# Altium schematic sheet MAZ000170 - Diagrama eléctrico.SchDoc: MAZ000170 - Diagrama eléctrico
size A; ApprovedBy: Christian Ledwidth; CheckedBy: Nahuel Martinez; Author: Santiago Marti; CompanyName: Body Health; DrawnBy: Santiago Marti; Revision: A; SheetNumber: 1; SheetTotal: 2
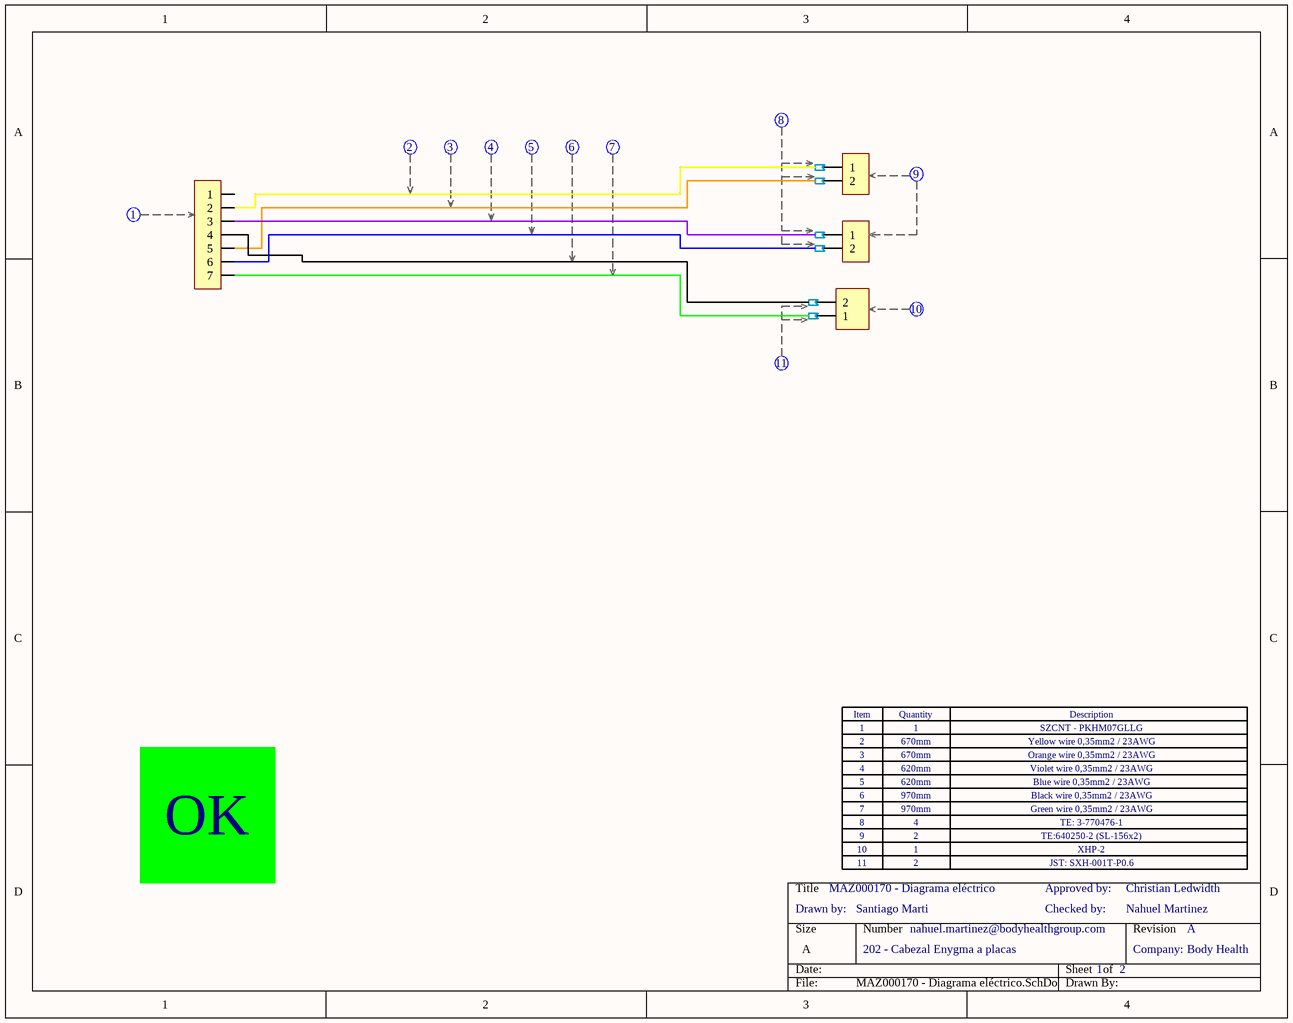
[diagram p0: MAZ000170 - Diagrama eléctrico.SchDoc]

## Parts
Con1  SL156-2  (value not drawn)  (part D of 4)
Con2  SL156-2  (value not drawn)  (part D of 4)
Con3  XHP-2  (value not drawn)  (part D of 4)
Conn1  SZCNT_07_Hembra  (value not drawn)  (parts B,C of 3)
Conn2  SZCNT_07_Hembra  (value not drawn)  (part B of 3)
Conn3  SZCNT_07_Hembra  (value not drawn)  (part B of 3)
Conn4  SZCNT_07_Hembra  (value not drawn)  (part B of 3)
Conn5  SZCNT_07_Hembra  (value not drawn)  (part B of 3)
Conn6  SZCNT_07_Hembra  (value not drawn)  (part B of 3)
Conn7  SZCNT_07_Hembra  (value not drawn)  (part B of 3)
Conn8  SZCNT_07_Hembra  (value not drawn)  (part B of 3)
Conn9  SZCNT_07_Hembra  (value not drawn)  (part B of 3)
Conn10  SZCNT_07_Hembra  (value not drawn)  (part B of 3)
Conn11  SZCNT_07_Hembra  (value not drawn)  (part B of 3)
Soc1  sock_SL156_770476-1  (value not drawn)  (part B of 2)
Soc2  sock_SL156_770476-1  (value not drawn)  (part B of 2)
Soc3  sock_SL156_770476-1  (value not drawn)  (part B of 2)
Soc4  sock_SL156_770476-1  (value not drawn)  (part B of 2)
Soc5  sock_XHP_SXH-002T-P0.6  (value not drawn)  (part B of 2)
Soc6  sock_SL156_770476-1  (value not drawn)  (part B of 2)
Zoc1  Zócalo_Header  (value not drawn)
Zoc2  Zócalo_Item  (value not drawn)
Zoc3  Zócalo_Item  (value not drawn)
Zoc4  Zócalo_Item  (value not drawn)
Zoc5  Zócalo_Item  (value not drawn)
Zoc6  Zócalo_Item  (value not drawn)
Zoc7  Zócalo_Item  (value not drawn)
Zoc8  Zócalo_Item  (value not drawn)
Zoc9  Zócalo_Item  (value not drawn)
Zoc10  Zócalo_Item  (value not drawn)
Zoc11  Zócalo_Item  (value not drawn)
Zoc12  Zócalo_Item  (value not drawn)

## Nets
NetCon1_1: Con1.1 Soc1.0
NetCon1_2: Con1.2 Soc2.0
NetCon2_1: Con2.1 Soc3.0
NetCon2_2: Con2.2 Soc4.0
NetCon3_1: Con3.1 Soc6.0
NetCon3_2: Con3.2 Soc5.0
NetConn1_2: Conn1.2 Soc1.1
NetConn1_3: Conn1.3 Soc3.1
NetConn1_4: Conn1.4 Soc5.1
NetConn1_5: Conn1.5 Soc2.1
NetConn1_6: Conn1.6 Soc4.1
NetConn1_7: Conn1.7 Soc6.1

Not connected (* = marked no-connect by the designer): Conn1 1

## Notes on the sheet
- 1
- 2
- 3
- 4
- 5
- 670mm
- 620mm
- SZCNT - PKHM07GLLG
- Yellow wire 0,35mm2 / 23AWG
- Orange wire 0,35mm2 / 23AWG
- Violet wire 0,35mm2 / 23AWG
- Blue wire 0,35mm2 / 23AWG
- OK
- 6
- 7
- 8
- 9
- 970mm
- Black wire 0,35mm2 / 23AWG
- Green wire 0,35mm2 / 23AWG
- TE: 3-770476-1
- TE:640250-2 (SL-156x2)
- Drawn by:
- 10
- 11
- Checked by:
- Approved by:
- XHP-2
- JST: SXH-001T-P0.6
- 202 - Cabezal Enygma a placas
- nahuel.martinez@bodyhealthgroup.com
- Company:
- (in symbol Zócalo_Header) Item; Quantity; Description

## Library data of the parts
Con1 Con2 = SL156-2: CONN RECEPT 2 POS W/RAMP SL-156; Cod.Fabricante: 640250-2; Fabricante: TE Connectivity AMP Connectors; Cod.DigiKey: A19950-ND; ComponentLink1Description: Manufacturer Link; ComponentLink1URL: https://www.te.com/commerce/DocumentDelivery/DDEController?Action=srchrtrv&DocNm=640250&DocType=Customer+Drawing&DocLang=English; DIGIKEYx50: 0.11420; CallOut: *; DIGIKEYx100: NO
Con3 = XHP-2: CONN HOUSING 2.5MM 2POS; Fabricante: JST Sales America Inc.; Cod.DigiKey: 455-2266-ND; Cod.Fabricante: XHP-2; ComponentLink1Description: Manufacturer Link; ComponentLink1URL: http://www.jst-mfg.com/product/pdf/eng/eXH.pdf; DIGIKEYx50: 0.05620; CallOut: *; DIGIKEYx100: NO
Conn1 = SZCNT_07_Hembra: Conector SZCNT 7 vías hembra para gabinete; CallOut: 8; Cod.DigiKey: Se compra a SZCNT; Cod.Fabricante: *; ComponentLink1Description: Manufacturer Link; ComponentLink1URL: *; DIGIKEYx100: *; Fabricante: SZCNT; DIGIKEYx50: *
Conn2 = SZCNT_07_Hembra: Conector SZCNT 7 vías hembra para gabinete; CallOut: 2; Cod.DigiKey: Se compra a SZCNT; Cod.Fabricante: *; ComponentLink1Description: Manufacturer Link; ComponentLink1URL: *; DIGIKEYx100: *; Fabricante: SZCNT; DIGIKEYx50: *
Conn3 = SZCNT_07_Hembra: Conector SZCNT 7 vías hembra para gabinete; CallOut: 3; Cod.DigiKey: Se compra a SZCNT; Cod.Fabricante: *; ComponentLink1Description: Manufacturer Link; ComponentLink1URL: *; DIGIKEYx100: *; Fabricante: SZCNT; DIGIKEYx50: *
Conn4 = SZCNT_07_Hembra: Conector SZCNT 7 vías hembra para gabinete; CallOut: 4; Cod.DigiKey: Se compra a SZCNT; Cod.Fabricante: *; ComponentLink1Description: Manufacturer Link; ComponentLink1URL: *; DIGIKEYx100: *; Fabricante: SZCNT; DIGIKEYx50: *
Conn5 = SZCNT_07_Hembra: Conector SZCNT 7 vías hembra para gabinete; CallOut: 5; Cod.DigiKey: Se compra a SZCNT; Cod.Fabricante: *; ComponentLink1Description: Manufacturer Link; ComponentLink1URL: *; DIGIKEYx100: *; Fabricante: SZCNT; DIGIKEYx50: *
Conn6 = SZCNT_07_Hembra: Conector SZCNT 7 vías hembra para gabinete; CallOut: 6; Cod.DigiKey: Se compra a SZCNT; Cod.Fabricante: *; ComponentLink1Description: Manufacturer Link; ComponentLink1URL: *; DIGIKEYx100: *; Fabricante: SZCNT; DIGIKEYx50: *
Conn7 = SZCNT_07_Hembra: Conector SZCNT 7 vías hembra para gabinete; CallOut: 7; Cod.DigiKey: Se compra a SZCNT; Cod.Fabricante: *; ComponentLink1Description: Manufacturer Link; ComponentLink1URL: *; DIGIKEYx100: *; Fabricante: SZCNT; DIGIKEYx50: *
Conn8 = SZCNT_07_Hembra: Conector SZCNT 7 vías hembra para gabinete; CallOut: 9; Cod.DigiKey: Se compra a SZCNT; Cod.Fabricante: *; ComponentLink1Description: Manufacturer Link; ComponentLink1URL: *; DIGIKEYx100: *; Fabricante: SZCNT; DIGIKEYx50: *
Conn9 = SZCNT_07_Hembra: Conector SZCNT 7 vías hembra para gabinete; CallOut: 1; Cod.DigiKey: Se compra a SZCNT; Cod.Fabricante: *; ComponentLink1Description: Manufacturer Link; ComponentLink1URL: *; DIGIKEYx100: *; Fabricante: SZCNT; DIGIKEYx50: *
Conn10 = SZCNT_07_Hembra: Conector SZCNT 7 vías hembra para gabinete; CallOut: 10; Cod.DigiKey: Se compra a SZCNT; Cod.Fabricante: *; ComponentLink1Description: Manufacturer Link; ComponentLink1URL: *; DIGIKEYx100: *; Fabricante: SZCNT; DIGIKEYx50: *
Conn11 = SZCNT_07_Hembra: Conector SZCNT 7 vías hembra para gabinete; CallOut: 11; Cod.DigiKey: Se compra a SZCNT; Cod.Fabricante: *; ComponentLink1Description: Manufacturer Link; ComponentLink1URL: *; DIGIKEYx100: *; Fabricante: SZCNT; DIGIKEYx50: *
Soc1-Soc4 Soc6 = sock_SL156_770476-1: CONN SOCKET 18-24AWG CRIMP TIN; Fabricante: TE Connectivity AMP Connectors; Cod.DigiKey: A19993CT-ND; Cod.Fabricante: 770476-1; ComponentLink1Description: Manufacturer Link; ComponentLink1URL: https://www.te.com/commerce/DocumentDelivery/DDEController?Action=srchrtrv&DocNm=770476&DocType=Customer+Drawing&DocLang=English; DIGIKEYx100: 0.08690; CallOut: *; DIGIKEYx50: 0.08180
Soc5 = sock_XHP_SXH-002T-P0.6: CONN SOCKET 26-30AWG CRIMP TIN; Fabricante: JST Sales America Inc.; Cod.DigiKey: 455-2261-1-ND; Cod.Fabricante: SXH-002T-P0.6; ComponentLink1Description: Manufacturer Link; ComponentLink1URL: http://www.jst-mfg.com/product/pdf/eng/eXH.pdf; DIGIKEYx100: 0.03300; CallOut: *; DIGIKEYx50: 0.03420
Zoc1 = Zócalo_Header: Header para el zócalo de referencias
Zoc2-Zoc12 = Zócalo_Item: Ítem para el zócalo de referencias; Desginator: *; Quantity: *; ItemDescription: *